# Altium schematic sheet Minion.SchDoc (part 2 of 4) (continued)
## Nets (continued)
U1_3.AE20(CORE_VDD) U1_3.AE22(CORE_VDD) U1_3.AE24(CORE_VDD) U1_3.AE26(CORE_VDD) U1_3.AE28(CORE_VDD) U1_3.AE30(CORE_VDD) U1_3.AF1(CORE_VDD) U1_3.AF3(CORE_VDD) U1_3.AF5(CORE_VDD) U1_3.AF7(CORE_VDD) U1_3.AF9(CORE_VDD) U1_3.AF11(CORE_VDD) U1_3.AF13(CORE_VDD) U1_3.AF15(CORE_VDD) U1_3.AF17(CORE_VDD) U1_3.AF19(CORE_VDD) U1_3.AF21(CORE_VDD) U1_3.AF23(CORE_VDD) U1_3.AF25(CORE_VDD) U1_3.AF27(CORE_VDD) U1_3.AF29(CORE_VDD) U1_3.AG2(CORE_VDD) U1_3.AG4(CORE_VDD) U1_3.AG6(CORE_VDD) U1_3.AG8(CORE_VDD) U1_3.AG10(CORE_VDD) U1_3.AG12(CORE_VDD) U1_3.AG14(CORE_VDD) U1_3.AG16(CORE_VDD) U1_3.AG18(CORE_VDD) U1_3.AG20(CORE_VDD) U1_3.AG22(CORE_VDD) U1_3.AG24(CORE_VDD) U1_3.AG26(CORE_VDD) U1_3.AG28(CORE_VDD) U1_3.AG30(CORE_VDD) U1_3.AH1(CORE_VDD) U1_3.AH3(CORE_VDD) U1_3.AH5(CORE_VDD) U1_3.AH7(CORE_VDD) U1_3.AH9(CORE_VDD) U1_3.AH11(CORE_VDD) U1_3.AH13(CORE_VDD) U1_3.AH15(CORE_VDD) U1_3.AH17(CORE_VDD) U1_3.AH19(CORE_VDD) U1_3.AH21(CORE_VDD) U1_3.AH23(CORE_VDD) U1_3.AH25(CORE_VDD) U1_3.AH27(CORE_VDD) U1_3.AH29(CORE_VDD) U1_3.AJ2(CORE_VDD) U1_3.AJ10(CORE_VDD) U1_3.AJ14(CORE_VDD) U1_3.AJ18(CORE_VDD) U1_3.AJ28(CORE_VDD) U1_3.AJ30(CORE_VDD) U1_3.AK1(CORE_VDD) U1_3.AK26(CORE_VDD) U1_3.AK29(CORE_VDD) U1_3.B1(CORE_VDD) U1_3.B3(CORE_VDD) U1_3.B5(CORE_VDD) U1_3.B7(CORE_VDD) U1_3.B9(CORE_VDD) U1_3.B11(CORE_VDD) U1_3.B13(CORE_VDD) U1_3.B15(CORE_VDD) U1_3.B17(CORE_VDD) U1_3.B19(CORE_VDD) U1_3.B21(CORE_VDD) U1_3.B23(CORE_VDD) U1_3.B25(CORE_VDD) U1_3.B27(CORE_VDD) U1_3.B29(CORE_VDD) U1_3.C2(CORE_VDD) U1_3.C4(CORE_VDD) U1_3.C6(CORE_VDD) U1_3.C8(CORE_VDD) U1_3.C10(CORE_VDD) U1_3.C12(CORE_VDD) U1_3.C14(CORE_VDD) U1_3.C16(CORE_VDD) U1_3.C18(CORE_VDD) U1_3.C20(CORE_VDD) U1_3.C22(CORE_VDD) U1_3.C24(CORE_VDD) U1_3.C26(CORE_VDD) U1_3.C28(CORE_VDD) U1_3.C30(CORE_VDD) U1_3.D1(CORE_VDD) U1_3.D3(CORE_VDD) U1_3.D5(CORE_VDD) U1_3.D7(CORE_VDD) U1_3.D9(CORE_VDD) U1_3.D11(CORE_VDD) U1_3.D13(CORE_VDD) U1_3.D15(CORE_VDD) U1_3.D17(CORE_VDD) U1_3.D19(CORE_VDD) U1_3.D21(CORE_VDD) U1_3.D23(CORE_VDD) U1_3.D25(CORE_VDD) U1_3.D27(CORE_VDD) U1_3.D29(CORE_VDD) U1_3.E2(CORE_VDD) U1_3.E4(CORE_VDD) U1_3.E6(CORE_VDD) U1_3.E8(CORE_VDD) U1_3.E10(CORE_VDD) U1_3.E12(CORE_VDD) U1_3.E14(CORE_VDD) U1_3.E16(CORE_VDD) U1_3.E18(CORE_VDD) U1_3.E20(CORE_VDD) U1_3.E22(CORE_VDD) U1_3.E24(CORE_VDD) U1_3.E26(CORE_VDD) U1_3.E28(CORE_VDD) U1_3.E30(CORE_VDD) U1_3.F1(CORE_VDD) U1_3.F3(CORE_VDD) U1_3.F5(CORE_VDD) U1_3.F7(CORE_VDD) U1_3.F9(CORE_VDD) U1_3.F11(CORE_VDD) U1_3.F13(CORE_VDD) U1_3.F15(CORE_VDD) U1_3.F17(CORE_VDD) U1_3.F19(CORE_VDD) U1_3.F21(CORE_VDD) U1_3.F23(CORE_VDD) U1_3.F25(CORE_VDD) U1_3.F27(CORE_VDD) U1_3.F29(CORE_VDD) U1_3.G2(CORE_VDD) U1_3.G4(CORE_VDD) U1_3.G6(CORE_VDD) U1_3.G8(CORE_VDD) U1_3.G10(CORE_VDD) U1_3.G12(CORE_VDD) U1_3.G14(CORE_VDD) U1_3.G16(CORE_VDD) U1_3.G18(CORE_VDD) U1_3.G20(CORE_VDD) U1_3.G22(CORE_VDD) U1_3.G24(CORE_VDD) U1_3.G26(CORE_VDD) U1_3.G28(CORE_VDD) U1_3.G30(CORE_VDD) U1_3.H1(CORE_VDD) U1_3.H3(CORE_VDD) U1_3.H5(CORE_VDD) U1_3.H7(CORE_VDD) U1_3.H9(CORE_VDD) U1_3.H11(CORE_VDD) U1_3.H13(CORE_VDD) U1_3.H15(CORE_VDD) U1_3.H17(CORE_VDD) U1_3.H19(CORE_VDD) U1_3.H21(CORE_VDD) U1_3.H23(CORE_VDD) U1_3.H25(CORE_VDD) U1_3.H27(CORE_VDD) U1_3.H29(CORE_VDD) U1_3.J2(CORE_VDD) U1_3.J4(CORE_VDD) U1_3.J6(CORE_VDD) U1_3.J8(CORE_VDD) U1_3.J10(CORE_VDD) U1_3.J12(CORE_VDD) U1_3.J14(CORE_VDD) U1_3.J16(CORE_VDD) U1_3.J18(CORE_VDD) U1_3.J20(CORE_VDD) U1_3.J22(CORE_VDD) U1_3.J24(CORE_VDD) U1_3.J26(CORE_VDD) U1_3.J28(CORE_VDD) U1_3.J30(CORE_VDD) U1_3.K1(CORE_VDD) U1_3.K3(CORE_VDD) U1_3.K5(CORE_VDD) U1_3.K7(CORE_VDD) U1_3.K9(CORE_VDD) U1_3.K11(CORE_VDD) U1_3.K13(CORE_VDD) U1_3.K15(CORE_VDD) U1_3.K17(CORE_VDD) U1_3.K19(CORE_VDD) U1_3.K21(CORE_VDD) U1_3.K23(CORE_VDD) U1_3.K25(CORE_VDD) U1_3.K27(CORE_VDD) U1_3.K29(CORE_VDD) U1_3.L2(CORE_VDD) U1_3.L4(CORE_VDD) U1_3.L6(CORE_VDD) U1_3.L8(CORE_VDD) U1_3.L10(CORE_VDD) U1_3.L12(CORE_VDD) U1_3.L14(CORE_VDD) U1_3.L16(CORE_VDD) U1_3.L18(CORE_VDD) U1_3.L20(CORE_VDD) U1_3.L22(CORE_VDD) U1_3.L24(CORE_VDD) U1_3.L26(CORE_VDD) U1_3.L28(CORE_VDD) U1_3.L30(CORE_VDD) U1_3.M1(CORE_VDD) U1_3.M3(CORE_VDD) U1_3.M5(CORE_VDD) U1_3.M7(CORE_VDD) U1_3.M9(CORE_VDD) U1_3.M11(CORE_VDD) U1_3.M13(CORE_VDD) U1_3.M15(CORE_VDD) U1_3.M17(CORE_VDD) U1_3.M19(CORE_VDD) U1_3.M21(CORE_VDD) U1_3.M23(CORE_VDD) U1_3.M25(CORE_VDD) U1_3.M27(CORE_VDD) U1_3.M29(CORE_VDD) U1_3.N2(CORE_VDD) U1_3.N4(CORE_VDD) U1_3.N6(CORE_VDD) U1_3.N8(CORE_VDD) U1_3.N10(CORE_VDD) U1_3.N12(CORE_VDD) U1_3.N14(CORE_VDD) U1_3.N16(CORE_VDD) U1_3.N18(CORE_VDD) U1_3.N20(CORE_VDD) U1_3.N22(CORE_VDD) U1_3.N24(CORE_VDD) U1_3.N26(CORE_VDD) U1_3.N28(CORE_VDD) U1_3.N30(CORE_VDD) U1_3.P1(CORE_VDD) U1_3.P3(CORE_VDD) U1_3.P5(CORE_VDD) U1_3.P7(CORE_VDD) U1_3.P9(CORE_VDD) U1_3.P11(CORE_VDD) U1_3.P13(CORE_VDD) U1_3.P15(CORE_VDD) U1_3.P17(CORE_VDD) U1_3.P19(CORE_VDD) U1_3.P21(CORE_VDD) U1_3.P23(CORE_VDD) U1_3.P25(CORE_VDD) U1_3.P27(CORE_VDD) U1_3.P29(CORE_VDD) U1_3.R2(CORE_VDD) U1_3.R4(CORE_VDD) U1_3.R6(CORE_VDD) U1_3.R8(CORE_VDD) U1_3.R10(CORE_VDD) U1_3.R12(CORE_VDD) U1_3.R14(CORE_VDD) U1_3.R16(CORE_VDD) U1_3.R18(CORE_VDD) U1_3.R20(CORE_VDD) U1_3.R22(CORE_VDD) U1_3.R24(CORE_VDD) U1_3.R26(CORE_VDD) U1_3.R28(CORE_VDD) U1_3.R30(CORE_VDD) U1_3.T1(CORE_VDD) U1_3.T3(CORE_VDD) U1_3.T5(CORE_VDD) U1_3.T7(CORE_VDD) U1_3.T9(CORE_VDD) U1_3.T11(CORE_VDD) U1_3.T13(CORE_VDD) U1_3.T15(CORE_VDD) U1_3.T17(CORE_VDD) U1_3.T19(CORE_VDD) U1_3.T21(CORE_VDD) U1_3.T23(CORE_VDD) U1_3.T25(CORE_VDD) U1_3.T27(CORE_VDD) U1_3.T29(CORE_VDD) U1_3.U2(CORE_VDD) U1_3.U4(CORE_VDD) U1_3.U6(CORE_VDD) U1_3.U8(CORE_VDD) U1_3.U10(CORE_VDD) U1_3.U12(CORE_VDD) U1_3.U14(CORE_VDD) U1_3.U16(CORE_VDD) U1_3.U18(CORE_VDD) U1_3.U20(CORE_VDD) U1_3.U22(CORE_VDD) U1_3.U24(CORE_VDD) U1_3.U26(CORE_VDD) U1_3.U28(CORE_VDD) U1_3.U30(CORE_VDD) U1_3.V1(CORE_VDD) U1_3.V3(CORE_VDD) U1_3.V5(CORE_VDD) U1_3.V7(CORE_VDD) U1_3.V9(CORE_VDD) U1_3.V11(CORE_VDD) U1_3.V13(CORE_VDD) U1_3.V15(CORE_VDD) U1_3.V17(CORE_VDD) U1_3.V19(CORE_VDD) U1_3.V21(CORE_VDD) U1_3.V23(CORE_VDD) U1_3.V25(CORE_VDD) U1_3.V27(CORE_VDD) U1_3.V29(CORE_VDD) U1_3.W2(CORE_VDD) U1_3.W4(CORE_VDD) U1_3.W6(CORE_VDD) U1_3.W8(CORE_VDD) U1_3.W10(CORE_VDD) U1_3.W12(CORE_VDD) U1_3.W14(CORE_VDD) U1_3.W16(CORE_VDD) U1_3.W18(CORE_VDD) U1_3.W20(CORE_VDD) U1_3.W22(CORE_VDD) U1_3.W24(CORE_VDD) U1_3.W26(CORE_VDD) U1_3.W28(CORE_VDD) U1_3.W30(CORE_VDD) U1_3.Y1(CORE_VDD) U1_3.Y3(CORE_VDD) U1_3.Y5(CORE_VDD) U1_3.Y7(CORE_VDD) U1_3.Y9(CORE_VDD) U1_3.Y11(CORE_VDD) U1_3.Y13(CORE_VDD) U1_3.Y15(CORE_VDD) U1_3.Y17(CORE_VDD) U1_3.Y19(CORE_VDD) U1_3.Y21(CORE_VDD) U1_3.Y23(CORE_VDD) U1_3.Y25(CORE_VDD) U1_3.Y27(CORE_VDD) U1_3.Y29(CORE_VDD) U1_4.A2(CORE_VDD) U1_4.A4(CORE_VDD) U1_4.A6(CORE_VDD) U1_4.A8(CORE_VDD) U1_4.A10(CORE_VDD) U1_4.A12(CORE_VDD) U1_4.A14(CORE_VDD) U1_4.A16(CORE_VDD) U1_4.A18(CORE_VDD) U1_4.A20(CORE_VDD) U1_4.A22(CORE_VDD) U1_4.A24(CORE_VDD) U1_4.A26(CORE_VDD) U1_4.A28(CORE_VDD) U1_4.A30(CORE_VDD) U1_4.AA2(CORE_VDD) U1_4.AA4(CORE_VDD) U1_4.AA6(CORE_VDD) U1_4.AA8(CORE_VDD) U1_4.AA10(CORE_VDD) U1_4.AA12(CORE_VDD) U1_4.AA14(CORE_VDD) U1_4.AA16(CORE_VDD) U1_4.AA18(CORE_VDD) U1_4.AA20(CORE_VDD) U1_4.AA22(CORE_VDD) U1_4.AA24(CORE_VDD) U1_4.AA26(CORE_VDD) U1_4.AA28(CORE_VDD) U1_4.AA30(CORE_VDD) U1_4.AB1(CORE_VDD) U1_4.AB3(CORE_VDD) U1_4.AB5(CORE_VDD) U1_4.AB7(CORE_VDD) U1_4.AB9(CORE_VDD) U1_4.AB11(CORE_VDD) U1_4.AB13(CORE_VDD) U1_4.AB15(CORE_VDD) U1_4.AB17(CORE_VDD) U1_4.AB19(CORE_VDD) U1_4.AB21(CORE_VDD) U1_4.AB23(CORE_VDD) U1_4.AB25(CORE_VDD) U1_4.AB27(CORE_VDD) U1_4.AB29(CORE_VDD) U1_4.AC2(CORE_VDD) U1_4.AC4(CORE_VDD) U1_4.AC6(CORE_VDD) U1_4.AC8(CORE_VDD) U1_4.AC10(CORE_VDD) U1_4.AC12(CORE_VDD) U1_4.AC14(CORE_VDD) U1_4.AC16(CORE_VDD) U1_4.AC18(CORE_VDD) U1_4.AC20(CORE_VDD) U1_4.AC22(CORE_VDD) U1_4.AC24(CORE_VDD) U1_4.AC26(CORE_VDD) U1_4.AC28(CORE_VDD) U1_4.AC30(CORE_VDD) U1_4.AD1(CORE_VDD) U1_4.AD3(CORE_VDD) U1_4.AD5(CORE_VDD) U1_4.AD7(CORE_VDD) U1_4.AD9(CORE_VDD) U1_4.AD11(CORE_VDD) U1_4.AD13(CORE_VDD) U1_4.AD15(CORE_VDD) U1_4.AD17(CORE_VDD) U1_4.AD19(CORE_VDD) U1_4.AD21(CORE_VDD) U1_4.AD23(CORE_VDD) U1_4.AD25(CORE_VDD) U1_4.AD27(CORE_VDD) U1_4.AD29(CORE_VDD) U1_4.AE2(CORE_VDD) U1_4.AE4(CORE_VDD) U1_4.AE6(CORE_VDD) U1_4.AE8(CORE_VDD) U1_4.AE10(CORE_VDD) U1_4.AE12(CORE_VDD) U1_4.AE14(CORE_VDD) U1_4.AE16(CORE_VDD) U1_4.AE18(CORE_VDD) U1_4.AE20(CORE_VDD) U1_4.AE22(CORE_VDD) U1_4.AE24(CORE_VDD) U1_4.AE26(CORE_VDD) U1_4.AE28(CORE_VDD) U1_4.AE30(CORE_VDD) U1_4.AF1(CORE_VDD) U1_4.AF3(CORE_VDD) U1_4.AF5(CORE_VDD) U1_4.AF7(CORE_VDD) U1_4.AF9(CORE_VDD) U1_4.AF11(CORE_VDD) U1_4.AF13(CORE_VDD) U1_4.AF15(CORE_VDD) U1_4.AF17(CORE_VDD) U1_4.AF19(CORE_VDD) U1_4.AF21(CORE_VDD) U1_4.AF23(CORE_VDD) U1_4.AF25(CORE_VDD) U1_4.AF27(CORE_VDD) U1_4.AF29(CORE_VDD) U1_4.AG2(CORE_VDD) U1_4.AG4(CORE_VDD) U1_4.AG6(CORE_VDD) U1_4.AG8(CORE_VDD) U1_4.AG10(CORE_VDD) U1_4.AG12(CORE_VDD) U1_4.AG14(CORE_VDD) U1_4.AG16(CORE_VDD) U1_4.AG18(CORE_VDD) U1_4.AG20(CORE_VDD) U1_4.AG22(CORE_VDD) U1_4.AG24(CORE_VDD) U1_4.AG26(CORE_VDD) U1_4.AG28(CORE_VDD) U1_4.AG30(CORE_VDD) U1_4.AH1(CORE_VDD) U1_4.AH3(CORE_VDD) U1_4.AH5(CORE_VDD) U1_4.AH7(CORE_VDD) U1_4.AH9(CORE_VDD) U1_4.AH11(CORE_VDD) U1_4.AH13(CORE_VDD) U1_4.AH15(CORE_VDD) U1_4.AH17(CORE_VDD) U1_4.AH19(CORE_VDD) U1_4.AH21(CORE_VDD) U1_4.AH23(CORE_VDD) U1_4.AH25(CORE_VDD) U1_4.AH27(CORE_VDD) U1_4.AH29(CORE_VDD) U1_4.AJ2(CORE_VDD) U1_4.AJ10(CORE_VDD) U1_4.AJ14(CORE_VDD) U1_4.AJ18(CORE_VDD) U1_4.AJ28(CORE_VDD) U1_4.AJ30(CORE_VDD) U1_4.AK1(CORE_VDD) U1_4.AK26(CORE_VDD) U1_4.AK29(CORE_VDD) U1_4.B1(CORE_VDD) U1_4.B3(CORE_VDD) U1_4.B5(CORE_VDD) U1_4.B7(CORE_VDD) U1_4.B9(CORE_VDD) U1_4.B11(CORE_VDD) U1_4.B13(CORE_VDD) U1_4.B15(CORE_VDD) U1_4.B17(CORE_VDD) U1_4.B19(CORE_VDD) U1_4.B21(CORE_VDD) U1_4.B23(CORE_VDD) U1_4.B25(CORE_VDD) U1_4.B27(CORE_VDD) U1_4.B29(CORE_VDD) U1_4.C2(CORE_VDD) U1_4.C4(CORE_VDD) U1_4.C6(CORE_VDD) U1_4.C8(CORE_VDD) U1_4.C10(CORE_VDD) U1_4.C12(CORE_VDD) U1_4.C14(CORE_VDD) U1_4.C16(CORE_VDD) U1_4.C18(CORE_VDD) U1_4.C20(CORE_VDD) U1_4.C22(CORE_VDD) U1_4.C24(CORE_VDD) U1_4.C26(CORE_VDD) U1_4.C28(CORE_VDD) U1_4.C30(CORE_VDD) U1_4.D1(CORE_VDD) U1_4.D3(CORE_VDD) U1_4.D5(CORE_VDD) U1_4.D7(CORE_VDD) U1_4.D9(CORE_VDD) U1_4.D11(CORE_VDD) U1_4.D13(CORE_VDD) U1_4.D15(CORE_VDD) U1_4.D17(CORE_VDD) U1_4.D19(CORE_VDD) U1_4.D21(CORE_VDD) U1_4.D23(CORE_VDD) U1_4.D25(CORE_VDD) U1_4.D27(CORE_VDD) U1_4.D29(CORE_VDD) U1_4.E2(CORE_VDD) U1_4.E4(CORE_VDD) U1_4.E6(CORE_VDD) U1_4.E8(CORE_VDD) U1_4.E10(CORE_VDD) U1_4.E12(CORE_VDD) U1_4.E14(CORE_VDD) U1_4.E16(CORE_VDD) U1_4.E18(CORE_VDD) U1_4.E20(CORE_VDD) U1_4.E22(CORE_VDD) U1_4.E24(CORE_VDD) U1_4.E26(CORE_VDD) U1_4.E28(CORE_VDD) U1_4.E30(CORE_VDD) U1_4.F1(CORE_VDD) U1_4.F3(CORE_VDD) U1_4.F5(CORE_VDD) U1_4.F7(CORE_VDD) U1_4.F9(CORE_VDD) U1_4.F11(CORE_VDD) U1_4.F13(CORE_VDD) U1_4.F15(CORE_VDD) U1_4.F17(CORE_VDD) U1_4.F19(CORE_VDD) U1_4.F21(CORE_VDD) U1_4.F23(CORE_VDD) U1_4.F25(CORE_VDD) U1_4.F27(CORE_VDD) U1_4.F29(CORE_VDD) U1_4.G2(CORE_VDD) U1_4.G4(CORE_VDD) U1_4.G6(CORE_VDD) U1_4.G8(CORE_VDD) U1_4.G10(CORE_VDD) U1_4.G12(CORE_VDD) U1_4.G14(CORE_VDD) U1_4.G16(CORE_VDD) U1_4.G18(CORE_VDD) U1_4.G20(CORE_VDD) U1_4.G22(CORE_VDD) U1_4.G24(CORE_VDD) U1_4.G26(CORE_VDD) U1_4.G28(CORE_VDD) U1_4.G30(CORE_VDD) U1_4.H1(CORE_VDD) U1_4.H3(CORE_VDD) U1_4.H5(CORE_VDD) U1_4.H7(CORE_VDD) U1_4.H9(CORE_VDD) U1_4.H11(CORE_VDD) U1_4.H13(CORE_VDD) U1_4.H15(CORE_VDD) U1_4.H17(CORE_VDD) U1_4.H19(CORE_VDD) U1_4.H21(CORE_VDD) U1_4.H23(CORE_VDD) U1_4.H25(CORE_VDD) U1_4.H27(CORE_VDD) U1_4.H29(CORE_VDD) U1_4.J2(CORE_VDD) U1_4.J4(CORE_VDD) U1_4.J6(CORE_VDD) U1_4.J8(CORE_VDD) U1_4.J10(CORE_VDD) U1_4.J12(CORE_VDD) U1_4.J14(CORE_VDD) U1_4.J16(CORE_VDD) U1_4.J18(CORE_VDD) U1_4.J20(CORE_VDD) U1_4.J22(CORE_VDD) U1_4.J24(CORE_VDD) U1_4.J26(CORE_VDD) U1_4.J28(CORE_VDD) U1_4.J30(CORE_VDD) U1_4.K1(CORE_VDD) U1_4.K3(CORE_VDD) U1_4.K5(CORE_VDD) U1_4.K7(CORE_VDD) U1_4.K9(CORE_VDD) U1_4.K11(CORE_VDD) U1_4.K13(CORE_VDD) U1_4.K15(CORE_VDD) U1_4.K17(CORE_VDD) U1_4.K19(CORE_VDD) U1_4.K21(CORE_VDD) U1_4.K23(CORE_VDD) U1_4.K25(CORE_VDD) U1_4.K27(CORE_VDD) U1_4.K29(CORE_VDD) U1_4.L2(CORE_VDD) U1_4.L4(CORE_VDD) U1_4.L6(CORE_VDD) U1_4.L8(CORE_VDD) U1_4.L10(CORE_VDD) U1_4.L12(CORE_VDD) U1_4.L14(CORE_VDD) U1_4.L16(CORE_VDD) U1_4.L18(CORE_VDD) U1_4.L20(CORE_VDD) U1_4.L22(CORE_VDD) U1_4.L24(CORE_VDD) U1_4.L26(CORE_VDD) U1_4.L28(CORE_VDD) U1_4.L30(CORE_VDD) U1_4.M1(CORE_VDD) U1_4.M3(CORE_VDD) U1_4.M5(CORE_VDD) U1_4.M7(CORE_VDD) U1_4.M9(CORE_VDD) U1_4.M11(CORE_VDD) U1_4.M13(CORE_VDD) U1_4.M15(CORE_VDD) U1_4.M17(CORE_VDD) U1_4.M19(CORE_VDD) U1_4.M21(CORE_VDD) U1_4.M23(CORE_VDD) U1_4.M25(CORE_VDD) U1_4.M27(CORE_VDD) U1_4.M29(CORE_VDD) U1_4.N2(CORE_VDD) U1_4.N4(CORE_VDD) U1_4.N6(CORE_VDD) U1_4.N8(CORE_VDD) U1_4.N10(CORE_VDD) U1_4.N12(CORE_VDD) U1_4.N14(CORE_VDD) U1_4.N16(CORE_VDD) U1_4.N18(CORE_VDD) U1_4.N20(CORE_VDD) U1_4.N22(CORE_VDD) U1_4.N24(CORE_VDD) U1_4.N26(CORE_VDD) U1_4.N28(CORE_VDD) U1_4.N30(CORE_VDD) U1_4.P1(CORE_VDD) U1_4.P3(CORE_VDD) U1_4.P5(CORE_VDD) U1_4.P7(CORE_VDD) U1_4.P9(CORE_VDD) U1_4.P11(CORE_VDD) U1_4.P13(CORE_VDD) U1_4.P15(CORE_VDD) U1_4.P17(CORE_VDD) U1_4.P19(CORE_VDD) U1_4.P21(CORE_VDD) U1_4.P23(CORE_VDD) U1_4.P25(CORE_VDD) U1_4.P27(CORE_VDD) U1_4.P29(CORE_VDD) U1_4.R2(CORE_VDD) U1_4.R4(CORE_VDD) U1_4.R6(CORE_VDD) U1_4.R8(CORE_VDD) U1_4.R10(CORE_VDD) U1_4.R12(CORE_VDD) U1_4.R14(CORE_VDD) U1_4.R16(CORE_VDD) U1_4.R18(CORE_VDD) U1_4.R20(CORE_VDD) U1_4.R22(CORE_VDD) U1_4.R24(CORE_VDD) U1_4.R26(CORE_VDD) U1_4.R28(CORE_VDD) U1_4.R30(CORE_VDD) U1_4.T1(CORE_VDD) U1_4.T3(CORE_VDD) U1_4.T5(CORE_VDD) U1_4.T7(CORE_VDD) U1_4.T9(CORE_VDD) U1_4.T11(CORE_VDD) U1_4.T13(CORE_VDD) U1_4.T15(CORE_VDD) U1_4.T17(CORE_VDD) U1_4.T19(CORE_VDD) U1_4.T21(CORE_VDD) U1_4.T23(CORE_VDD) U1_4.T25(CORE_VDD) U1_4.T27(CORE_VDD) U1_4.T29(CORE_VDD) U1_4.U2(CORE_VDD) U1_4.U4(CORE_VDD) U1_4.U6(CORE_VDD) U1_4.U8(CORE_VDD) U1_4.U10(CORE_VDD) U1_4.U12(CORE_VDD) U1_4.U14(CORE_VDD) U1_4.U16(CORE_VDD) U1_4.U18(CORE_VDD) U1_4.U20(CORE_VDD) U1_4.U22(CORE_VDD) U1_4.U24(CORE_VDD) U1_4.U26(CORE_VDD) U1_4.U28(CORE_VDD) U1_4.U30(CORE_VDD) U1_4.V1(CORE_VDD) U1_4.V3(CORE_VDD) U1_4.V5(CORE_VDD) U1_4.V7(CORE_VDD) U1_4.V9(CORE_VDD) U1_4.V11(CORE_VDD) U1_4.V13(CORE_VDD) U1_4.V15(CORE_VDD) U1_4.V17(CORE_VDD) U1_4.V19(CORE_VDD) U1_4.V21(CORE_VDD) U1_4.V23(CORE_VDD) U1_4.V25(CORE_VDD) U1_4.V27(CORE_VDD) U1_4.V29(CORE_VDD) U1_4.W2(CORE_VDD) U1_4.W4(CORE_VDD) U1_4.W6(CORE_VDD) U1_4.W8(CORE_VDD) U1_4.W10(CORE_VDD) U1_4.W12(CORE_VDD) U1_4.W14(CORE_VDD) U1_4.W16(CORE_VDD) U1_4.W18(CORE_VDD) U1_4.W20(CORE_VDD) U1_4.W22(CORE_VDD) U1_4.W24(CORE_VDD) U1_4.W26(CORE_VDD) U1_4.W28(CORE_VDD) U1_4.W30(CORE_VDD) U1_4.Y1(CORE_VDD) U1_4.Y3(CORE_VDD) U1_4.Y5(CORE_VDD) U1_4.Y7(CORE_VDD) U1_4.Y9(CORE_VDD) U1_4.Y11(CORE_VDD) U1_4.Y13(CORE_VDD) U1_4.Y15(CORE_VDD) U1_4.Y17(CORE_VDD) U1_4.Y19(CORE_VDD) U1_4.Y21(CORE_VDD) U1_4.Y23(CORE_VDD) U1_4.Y25(CORE_VDD) U1_4.Y27(CORE_VDD) U1_4.Y29(CORE_VDD)